# EasyEDA Pro project ProProject_IMUSensorNodes202312.epro, board 6_6_拼板20240123（不带编号） (continued)
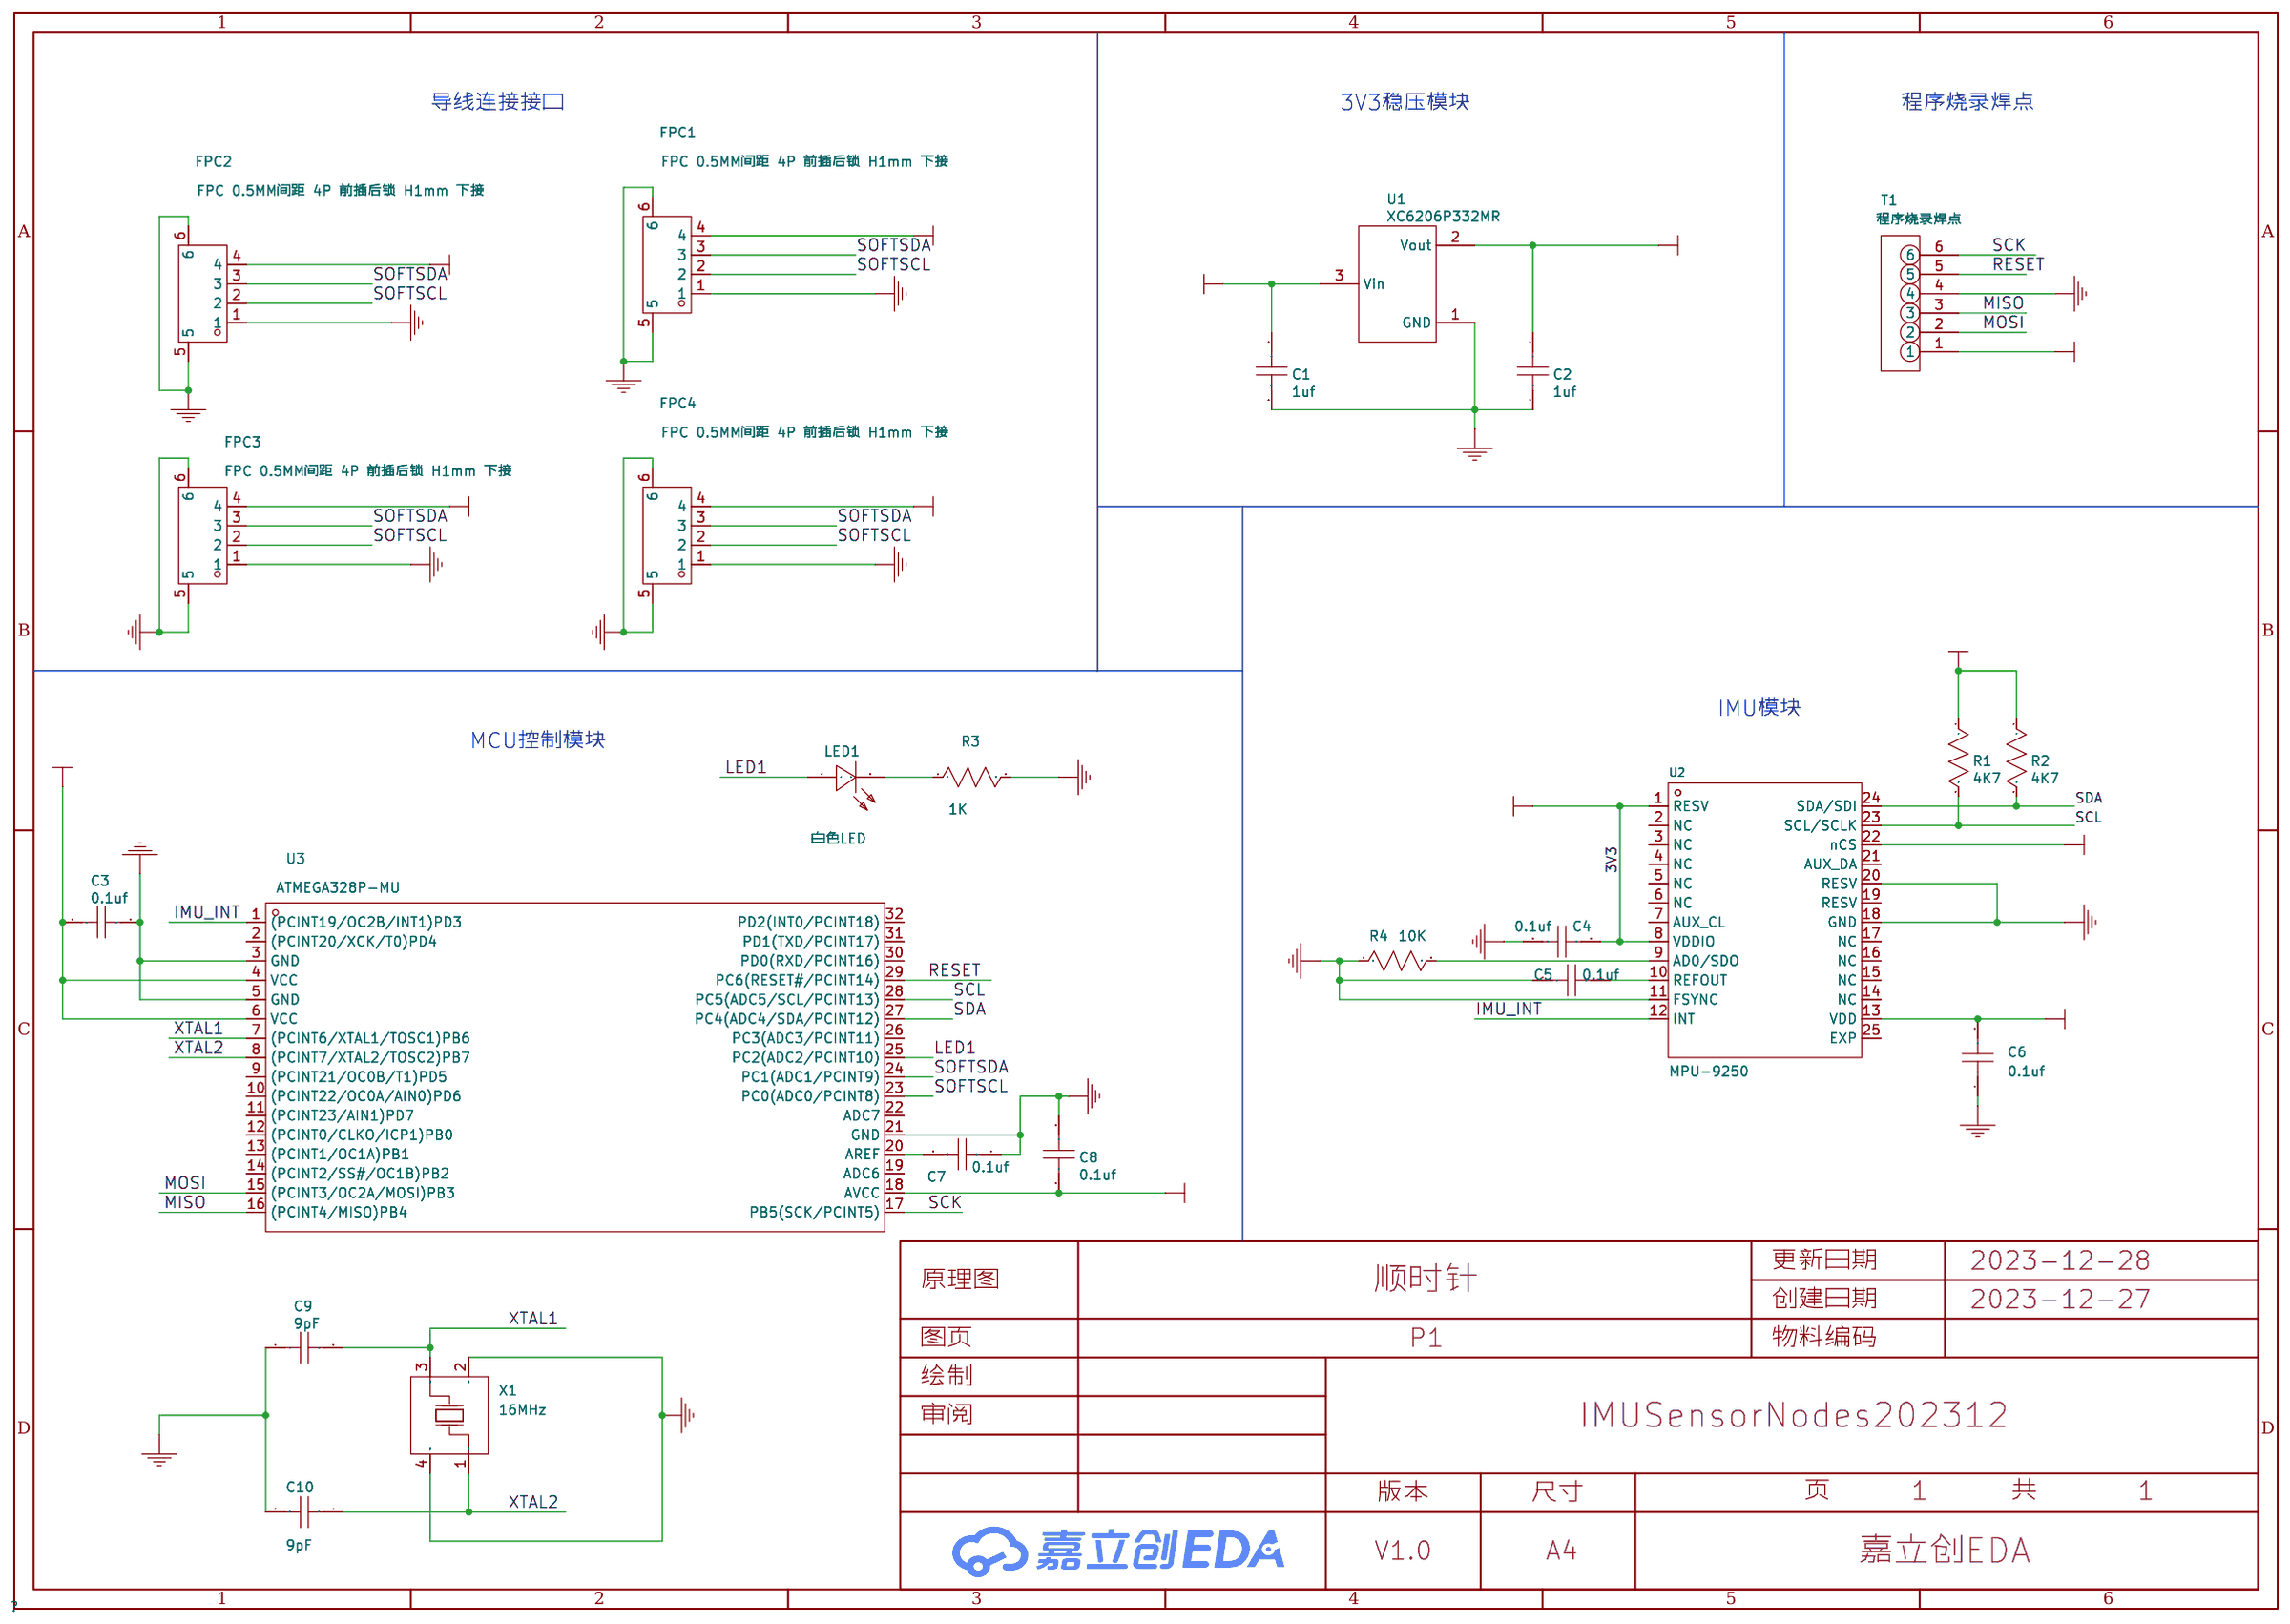
[diagram p0: schematic sheet]
## Routing (per net, layer and track width the routed paths; a pad name or vN(x,y) marks a point on that pad's centre or on a via; arc(x,y) is an arc through that point) (continued)
  vias: v1(3.33,70.26) v1(3.33,56.54) v1(3.33,42.83) v1(3.33,29.11) v1(3.33,15.4) v1(3.33,1.68) v1(17.05,69.88) v1(17.05,56.16) v1(17.05,42.45) v1(17.05,28.73) v1(17.05,15.01) v1(17.05,1.3) v1(30.64,70.26) v1(30.64,56.54) v1(30.64,42.83) v1(30.64,29.11) v1(30.64,15.4) v1(30.64,1.68) v1(44.35,69.88) v1(44.35,56.16) v1(44.35,42.45) v1(44.35,28.73) v1(44.35,15.01) v1(44.35,1.3) v1(57.94,70.26) v1(57.94,56.54) v1(57.94,42.83) v1(57.94,29.11) v1(57.94,15.4) v1(57.94,1.68) v1(71.66,69.88) v1(71.66,56.16) v1(71.66,42.45) v1(71.66,28.73) v1(71.66,15.01) v1(71.66,1.3)
SOFTSDA: length 633.1
  Top Layer w0.2: FPC2#8.2 6.25,76.73 6,76.48 3.08,76.48 2.32,75.72 2.32,75.09 2.57,74.83 FPC1#4.2 ; FPC1#13.2 2.57,6.25 2.32,6.51 2.32,7.14 3.08,7.9 6,7.9 6.25,8.15 FPC2#4.2 ; FPC1#15.3 72.43,74.33 72.93,74.83 72.93,77.75 73.31,78.13 73.92,78.13 74.08,77.98 FPC2#3.3 ; FPC2#22.3 46.77,9.4 46.62,9.55 46,9.55 45.62,9.17 45.62,6.25 45.12,5.75 FPC1#22.3 ; FPC1#7.3 72.43,5.75 72.93,6.25 72.93,9.17 73.31,9.55 73.92,9.55 74.08,9.4 FPC2#15.3 ; FPC2#2.3 46.77,77.98 46.62,78.13 46,78.13 45.62,77.75 45.62,74.83 45.12,74.33 FPC1#20.3 ; FPC1#21.2 29.88,19.96 29.62,20.22 29.62,20.86 30.38,21.62 33.31,21.62 33.56,21.87 FPC2#33.2 ; FPC1#33.3 17.82,33.18 18.32,33.68 18.32,36.61 18.7,36.99 19.31,36.99 19.47,36.83 FPC2#17.3 ; FPC2#12.2 60.86,63.02 60.61,62.77 57.69,62.77 56.93,62 56.93,61.37 57.18,61.11 FPC1#6.2 ; FPC1#3.3 72.43,33.18 72.93,33.68 72.93,36.61 73.31,36.99 73.92,36.99 74.08,36.83 FPC2#18.3 ; FPC1#5.2 2.57,19.96 2.32,20.22 2.32,20.86 3.08,21.62 6,21.62 6.25,21.87 FPC2#6.2 ; FPC1#17.2 57.18,47.4 56.93,47.65 56.93,48.29 57.69,49.05 60.61,49.05 60.86,49.3 FPC2#25.2 ; FPC1#36.2 29.88,33.68 29.62,33.94 29.62,34.57 30.38,35.33 33.31,35.33 33.56,35.59 FPC2#21.2 ; FPC2#7.2 60.86,35.59 60.61,35.33 57.69,35.33 56.93,34.57 56.93,33.94 57.18,33.68 FPC1#24.2 ; FPC2#28.3 19.47,64.26 19.31,64.42 18.7,64.42 18.32,64.04 18.32,61.12 17.82,60.61 FPC1#23.3 ; FPC2#30.3 19.47,77.98 19.31,78.13 18.7,78.13 18.32,77.75 18.32,74.83 17.82,74.33 FPC1#35.3 ; FPC2#14.3 19.47,9.4 19.31,9.55 18.7,9.55 18.32,9.17 18.32,6.25 17.82,5.75 FPC1#10.3 ; FPC1.2 2.57,61.11 2.32,61.37 2.32,62 3.08,62.77 6,62.77 6.25,63.02 FPC2#19.2 ; FPC1#14.2 29.88,61.11 29.62,61.37 29.62,62 30.38,62.77 33.31,62.77 33.56,63.02 FPC2#35.2 ; FPC2#23.2 33.56,76.73 33.31,76.48 30.38,76.48 29.62,75.72 29.62,75.09 29.88,74.83 FPC1#31.2 ; FPC1#30.3 72.43,60.61 72.93,61.12 72.93,64.04 73.31,64.42 73.92,64.42 74.08,64.26 FPC2#31.3 ; FPC2#13.2 6.25,35.59 6,35.33 3.08,35.33 2.32,34.57 2.32,33.94 2.57,33.68 FPC1#12.2 ; FPC1#28.2 57.18,6.25 56.93,6.51 56.93,7.14 57.69,7.9 60.61,7.9 60.86,8.15 FPC2#32.2 ; FPC2#34.2 60.86,21.87 60.61,21.62 57.69,21.62 56.93,20.86 56.93,20.22 57.18,19.96 FPC1#34.2 ; FPC2#11.2 60.86,76.73 60.61,76.48 57.69,76.48 56.93,75.72 56.93,75.09 57.18,74.83 FPC1#8.2 ; FPC1#26.3 45.12,33.18 45.62,33.68 45.62,36.61 46,36.99 46.62,36.99 46.77,36.83 FPC2#27.3 ; FPC1#19.3 17.82,19.46 18.32,19.97 18.32,22.89 18.7,23.27 19.31,23.27 19.47,23.11 FPC2#5.3 ; FPC2#26.3 46.77,64.26 46.62,64.42 46,64.42 45.62,64.04 45.62,61.12 45.12,60.61 FPC1#11.3 ; FPC1#25.3 72.43,19.46 72.93,19.97 72.93,22.89 73.31,23.27 73.92,23.27 74.08,23.11 FPC2#20.3 ; FPC1#29.3 72.43,46.9 72.93,47.4 72.93,50.32 73.31,50.7 73.92,50.7 74.08,50.55 FPC2.3 ; FPC1#32.2 2.57,47.4 2.32,47.65 2.32,48.29 3.08,49.05 6,49.05 6.25,49.3 FPC2#10.2 ; FPC2#24.3 46.77,50.55 46.62,50.7 46,50.7 45.62,50.32 45.62,47.4 45.12,46.9 FPC1#16.3 ; FPC1#9.3 45.12,19.46 45.62,19.97 45.62,22.89 46,23.27 46.62,23.27 46.77,23.11 FPC2#16.3 ; FPC1#18.2 29.88,47.4 29.62,47.65 29.62,48.29 30.38,49.05 33.31,49.05 33.56,49.3 FPC2#9.2 ; FPC1#27.3 17.82,46.9 18.32,47.4 18.32,50.32 18.7,50.7 19.31,50.7 19.47,50.55 FPC2#29.3 ; FPC1#2.2 29.88,6.25 29.62,6.51 29.62,7.14 30.38,7.9 33.31,7.9 33.56,8.15 FPC2#36.2
  Top Layer w0.254: v1(43.47,28.73) 43.85,29.11 43.85,29.87 ; FPC2#26.3 46.77,62.89 47.28,62.39 50.45,62.39 50.96,61.88 50.96,61.37 50.7,61.11 FPC3#24.3 48.67,61.11 48.23,60.67 48.23,57.37 48.04,57.18 47.66,57.18 47.27,57.56 FPC4#21.3 ; FPC3#17.2 35.21,60.61 34.96,60.86 34.7,60.86 34.57,60.99 34.57,64.29 34.32,64.55 33.81,64.55 33.56,64.29 FPC2#35.2 ; 43.85,71.02 43.85,70.26 v1(43.47,69.88) ; 43.85,2.44 43.85,1.68 v1(43.47,1.3) ; 16.54,2.44 16.54,1.68 v1(16.16,1.3) ; FPC3#27.2 7.9,33.18 7.65,33.43 7.4,33.43 7.27,33.56 7.27,36.86 7.02,37.11 6.51,37.11 6.25,36.86 FPC2#13.2 ; FPC2#3.3 74.08,76.61 74.58,76.1 77.75,76.1 78.26,75.59 78.26,75.09 78,74.83 FPC3#4.3 75.97,74.83 75.53,74.39 75.53,71.09 75.34,70.89 74.96,70.89 74.58,71.28 FPC4#16.3 ; 71.15,43.59 71.15,42.83 v1(70.77,42.45) ; 16.54,57.31 16.54,56.54 v1(16.16,56.16) ; FPC2#36.2 33.56,9.43 33.81,9.68 34.32,9.68 34.57,9.43 34.57,6.12 34.7,6 34.96,6 35.21,5.75 FPC3#14.2 ; FPC3#32.2 62.51,46.9 62.26,47.15 62.01,47.15 61.88,47.27 61.88,50.58 61.63,50.83 61.12,50.83 60.86,50.57 FPC2#25.2 ; FPC2#10.2 6.25,50.57 6.51,50.83 7.02,50.83 7.27,50.58 7.27,47.27 7.4,47.15 7.65,47.15 7.9,46.9 FPC3#10.2 ; FPC2#2.3 46.77,76.61 47.28,76.1 50.45,76.1 50.96,75.59 50.96,75.09 50.7,74.83 FPC3#21.3 48.67,74.83 48.23,74.39 48.23,71.09 48.04,70.89 47.66,70.89 47.27,71.28 FPC4#14.3 ; v1(16.16,42.45) 16.54,42.83 16.54,43.59 ; FPC2#30.3 19.47,76.61 19.97,76.1 23.15,76.1 23.65,75.59 23.65,75.09 23.39,74.83 FPC3#16.3 21.36,74.83 20.92,74.39 20.92,71.09 20.73,70.89 20.35,70.89 19.97,71.28 FPC4#26.3 ; FPC4#5.3 74.58,2.7 74.96,2.31 75.34,2.31 75.53,2.51 75.53,5.81 75.97,6.25 FPC3#35.3 78,6.25 78.26,6.51 78.26,7.01 77.75,7.52 74.58,7.52 74.08,8.03 FPC2#15.3 ; 16.54,71.02 16.54,70.26 v1(16.16,69.88) ; FPC2#21.2 33.56,36.86 33.81,37.11 34.32,37.11 34.57,36.86 34.57,33.56 34.7,33.43 34.96,33.43 35.21,33.18 FPC3.2 ; FPC4#2.3 47.27,2.7 47.66,2.31 48.04,2.31 48.23,2.51 48.23,5.81 48.67,6.25 FPC3#34.3 50.7,6.25 50.96,6.51 50.96,7.01 50.45,7.52 47.28,7.52 46.77,8.03 FPC2#22.3 ; FPC4#24.3 47.27,30.13 47.66,29.75 48.04,29.75 48.23,29.94 48.23,33.24 48.67,33.68 FPC3#9.3 50.7,33.68 50.96,33.94 50.96,34.45 50.45,34.95 47.28,34.95 46.77,35.46 FPC2#27.3 ; FPC3#20.2 35.21,74.33 34.96,74.58 34.7,74.58 34.57,74.7 34.57,78.01 34.32,78.26 33.81,78.26 33.56,78 FPC2#23.2 ; FPC4#9.3 74.58,57.56 74.96,57.18 75.34,57.18 75.53,57.37 75.53,60.67 75.97,61.11 FPC3#11.3 78,61.11 78.26,61.37 78.26,61.88 77.75,62.39 74.58,62.39 74.08,62.89 FPC2#31.3 ; 71.15,16.16 71.15,15.4 v1(70.77,15.01) ; 43.85,16.16 43.85,15.4 v1(43.47,15.01) ; FPC4#22.3 19.97,43.85 20.35,43.46 20.73,43.46 20.92,43.66 20.92,46.96 21.36,47.4 FPC3#28.3 23.39,47.4 23.65,47.65 23.65,48.16 23.15,48.67 19.97,48.67 19.47,49.17 FPC2#29.3 ; FPC2#33.2 33.56,23.14 33.81,23.4 34.32,23.4 34.57,23.14 34.57,19.84 34.7,19.71 34.96,19.71 35.21,19.46 FPC3#6.2 ; FPC3#36.2 7.9,74.33 7.65,74.58 7.4,74.58 7.27,74.7 7.27,78.01 7.02,78.26 6.51,78.26 6.25,78 FPC2#8.2 ; FPC3#13.2 62.51,19.46 62.26,19.71 62.01,19.71 61.88,19.84 61.88,23.14 61.63,23.4 61.12,23.4 60.86,23.14 FPC2#34.2 ; 43.85,57.31 43.85,56.54 v1(43.47,56.16) ; 71.15,2.44 71.15,1.68 v1(70.77,1.3) ; v1(70.77,69.88) 71.15,70.26 71.15,71.02 ; FPC2#6.2 6.25,23.14 6.51,23.4 7.02,23.4 7.27,23.14 7.27,19.84 7.4,19.71 7.65,19.71 7.9,19.46 FPC3#12.2 ; FPC4#28.3 19.97,16.42 20.35,16.03 20.73,16.03 20.92,16.22 20.92,19.53 21.36,19.96 FPC3#2.3 23.39,19.96 23.65,20.22 23.65,20.73 23.15,21.24 19.97,21.24 19.47,21.74 FPC2#5.3 ; FPC3#15.2 7.9,5.75 7.65,6 7.4,6 7.27,6.12 7.27,9.43 7.02,9.68 6.51,9.68 6.25,9.43 FPC2#4.2 ; FPC3#31.2 62.51,33.18 62.26,33.43 62.01,33.43 61.88,33.56 61.88,36.86 61.63,37.11 61.12,37.11 60.86,36.86 FPC2#7.2 ; FPC4#34.3 19.97,2.7 20.35,2.31 20.73,2.31 20.92,2.51 20.92,5.81 21.36,6.25 FPC3#29.3 23.39,6.25 23.65,6.51 23.65,7.01 23.15,7.52 19.97,7.52 19.47,8.03 FPC2#14.3 ; FPC2#32.2 60.86,9.43 61.12,9.68 61.63,9.68 61.88,9.43 61.88,6.12 62.01,6 62.26,6 62.51,5.75 FPC3#5.2 ; 71.15,29.87 71.15,29.11 v1(70.77,28.73) ; FPC2.3 74.08,49.17 74.58,48.67 77.75,48.67 78.26,48.16 78.26,47.65 78,47.4 FPC3#33.3 75.97,47.4 75.53,46.96 75.53,43.66 75.34,43.46 74.96,43.46 74.58,43.85 FPC4#20.3 ; FPC2#11.2 60.86,78 61.12,78.26 61.63,78.26 61.88,78.01 61.88,74.7 62.01,74.58 62.26,74.58 62.51,74.33 FPC3#25.2 ; FPC4#29.3 74.58,30.13 74.96,29.75 75.34,29.75 75.53,29.94 75.53,33.24 75.97,33.68 FPC3#23.3 78,33.68 78.26,33.94 78.26,34.45 77.75,34.95 74.58,34.95 74.08,35.46 FPC2#18.3 ; v1(70.77,56.16) 71.15,56.54 71.15,57.31 ; FPC4#32.3 47.27,16.42 47.66,16.03 48.04,16.03 48.23,16.22 48.23,19.53 48.67,19.96 FPC3#18.3 50.7,19.96 50.96,20.22 50.96,20.73 50.45,21.24 47.28,21.24 46.77,21.74 FPC2#16.3 ; FPC2#24.3 46.77,49.17 47.28,48.67 50.45,48.67 50.96,48.16 50.96,47.65 50.7,47.4 FPC3#22.3 48.67,47.4 48.23,46.96 48.23,43.66 48.04,43.46 47.66,43.46 47.27,43.85 FPC4#10.3 ; 16.54,29.87 16.54,29.11 v1(16.16,28.73) ; FPC2#20.3 74.08,21.74 74.58,21.24 77.75,21.24 78.26,20.73 78.26,20.22 78,19.96 FPC3#3.3 75.97,19.96 75.53,19.53 75.53,16.22 75.34,16.03 74.96,16.03 74.58,16.42 FPC4#31.3 ; FPC2#12.2 60.86,64.29 61.12,64.55 61.63,64.55 61.88,64.29 61.88,60.99 62.01,60.86 62.26,60.86 62.51,60.61 FPC3#30.2 ; v1(16.16,15.01) 16.54,15.4 16.54,16.16 ; FPC3#8.2 7.9,60.61 7.65,60.86 7.4,60.86 7.27,60.99 7.27,64.29 7.02,64.55 6.51,64.55 6.25,64.29 FPC2#19.2 ; FPC2#9.2 33.56,50.57 33.81,50.83 34.32,50.83 34.57,50.58 34.57,47.27 34.7,47.15 34.96,47.15 35.21,46.9 FPC3#26.2 ; FPC4#4.3 19.97,57.56 20.35,57.18 20.73,57.18 20.92,57.37 20.92,60.67 21.36,61.11 FPC3#19.3 23.39,61.11 23.65,61.37 23.65,61.88 23.15,62.39 19.97,62.39 19.47,62.89 FPC2#28.3 ; FPC4#15.3 19.97,30.13 20.35,29.75 20.73,29.75 20.92,29.94 20.92,33.24 21.36,33.68 FPC3#7.3 23.39,33.68 23.65,33.94 23.65,34.45 23.15,34.95 19.97,34.95 19.47,35.46 FPC2#17.3 ; 43.85,43.59 43.85,42.83 v1(43.47,42.45)
  vias: v1(2.44,69.75) v1(2.44,56.04) v1(2.44,42.32) v1(2.44,28.6) v1(2.44,14.89) v1(2.44,1.17) v1(29.75,69.75) v1(29.75,56.04) v1(29.75,42.32) v1(29.75,28.6) v1(29.75,14.89) v1(29.75,1.17) v1(57.05,69.75) v1(57.05,56.04) v1(57.05,42.32) v1(57.05,28.6) v1(57.05,14.89) v1(57.05,1.17)
XTAL1: length 220.2
  Bottom Layer w0.2: U3#87.7 73.92,34.3 74.2,34.57 74.91,34.57 76.74,36.4 v1(76.74,37.62) ; v1(35.79,78.77) 35.79,77.58 34.19,75.97 33.43,75.97 32.9,75.45 U3#77.7 ; v1(22.13,23.91) 22.13,22.68 20.31,20.86 19.59,20.86 19.31,20.58 U3#95.7 ; v1(35.79,51.34) 35.79,50.14 34.19,48.54 33.43,48.54 32.9,48.02 U3#75.7 ; U3#92.7 32.9,6.87 33.43,7.4 34.19,7.4 35.79,9 v1(35.79,10.19) ; v1(8.49,10.19) 8.49,9 6.89,7.4 6.13,7.4 5.6,6.87 U3#91.7 ; v1(49.43,51.34) 49.43,50.11 47.61,48.29 46.89,48.29 46.62,48.02 U3#64.7 ; v1(49.43,78.77) 49.43,77.55 47.61,75.72 46.89,75.72 46.62,75.45 U3#69.7 ; v1(8.49,23.91) 8.49,22.71 6.89,21.11 6.13,21.11 5.6,20.58 U3#72.7 ; v1(76.74,51.34) 76.74,50.11 74.91,48.29 74.2,48.29 73.92,48.02 U3#67.7 ; v1(63.1,37.62) 63.1,36.43 61.5,34.83 60.74,34.83 60.21,34.3 U3#82.7 ; U3#78.7 46.62,61.73 46.89,62 47.61,62 49.43,63.83 v1(49.43,65.05) ; v1(35.79,37.62) 35.79,36.43 34.19,34.83 33.43,34.83 32.9,34.3 U3#70.7 ; U3#84.7 19.31,48.02 19.59,48.29 20.31,48.29 22.13,50.11 v1(22.13,51.34) ; v1(49.43,23.91) 49.43,22.68 47.61,20.86 46.89,20.86 46.62,20.58 U3#62.7 ; U3#74.7 5.6,61.73 6.13,62.26 6.89,62.26 8.49,63.86 v1(8.49,65.05) ; U3#94.7 73.92,20.58 74.2,20.86 74.91,20.86 76.74,22.68 v1(76.74,23.91) ; v1(76.74,78.77) 76.74,77.55 74.91,75.72 74.2,75.72 73.92,75.45 U3#83.7 ; U3#73.7 32.9,20.58 33.43,21.11 34.19,21.11 35.79,22.71 v1(35.79,23.91) ; U3#63.7 60.21,61.73 60.74,62.26 61.5,62.26 63.1,63.86 v1(63.1,65.05) ; v1(22.13,65.05) 22.13,63.83 20.31,62 19.59,62 19.31,61.73 U3#88.7 ; v1(49.43,10.19) 49.43,8.97 47.61,7.14 46.89,7.14 46.62,6.87 U3#86.7 ; v1(76.74,10.19) 76.74,8.97 74.91,7.14 74.2,7.14 73.92,6.87 U3#80.7 ; U3#61.7 73.92,61.73 74.2,62 74.91,62 76.74,63.83 v1(76.74,65.05) ; U3#66.7 60.21,75.45 60.74,75.97 61.5,75.97 63.1,77.58 v1(63.1,78.77) ; U3#89.7 60.21,48.02 60.74,48.54 61.5,48.54 63.1,50.14 v1(63.1,51.34) ; v1(22.13,37.62) 22.13,36.4 20.31,34.57 19.59,34.57 19.31,34.3 U3#81.7 ; v1(35.79,65.05) 35.79,63.86 34.19,62.26 33.43,62.26 32.9,61.73 U3#76.7 ; U3#85.7 60.21,6.87 60.74,7.4 61.5,7.4 63.1,9 v1(63.1,10.19) ; v1(8.49,78.77) 8.49,77.58 6.89,75.97 6.13,75.97 5.6,75.45 U3#96.7 ; v1(22.13,10.19) 22.13,8.97 20.31,7.14 19.59,7.14 19.31,6.87 U3#90.7 ; v1(8.49,51.34) 8.49,50.14 6.89,48.54 6.13,48.54 5.6,48.02 U3#68.7 ; U3#65.7 5.6,34.3 6.13,34.83 6.89,34.83 8.49,36.43 v1(8.49,37.62) ; U3#93.7 60.21,20.58 60.74,21.11 61.5,21.11 63.1,22.71 v1(63.1,23.91) ; U3#71.7 19.31,75.45 19.59,75.72 20.31,75.72 22.13,77.55 v1(22.13,78.77) ; U3#79.7 46.62,34.3 46.89,34.57 47.61,34.57 49.43,36.4 v1(49.43,37.62)
  Bottom Layer w0.254: 8.54,51.34 8.54,51.49 C9#31.2 ; 63.15,23.91 63.15,24.06 C9.2 ; 8.54,65.05 8.54,65.21 C9#25.2 ; 22.64,10.7 v1(22.13,10.19) ; 22.64,65.56 v1(22.13,65.05) ; 77.25,38.13 v1(76.74,37.62) ; 35.84,51.34 35.84,51.49 C9#33.2 ; 8.54,23.91 8.54,24.06 C9#10.2 ; C9#12.2 35.84,24.06 35.84,23.91 ; C9#35.2 63.15,51.49 63.15,51.34 ; 63.15,37.62 63.15,37.78 C9#7.2 ; 8.54,78.77 8.54,78.92 C9#20.2 ; 35.84,65.05 35.84,65.21 C9#27.2 ; 22.64,79.28 v1(22.13,78.77) ; 8.54,37.62 8.54,37.78 C9#3.2 ; 49.94,38.13 v1(49.43,37.62) ; 77.25,10.7 v1(76.74,10.19) ; C9#14.2 8.54,10.34 8.54,10.19 ; C9#5.2 35.84,37.78 35.84,37.62 ; 77.25,79.28 v1(76.74,78.77) ; 49.94,51.84 v1(49.43,51.34) ; C9#16.2 35.84,10.34 35.84,10.19 ; 49.94,10.7 v1(49.43,10.19) ; 35.84,78.77 35.84,78.92 C9#23.2 ; 22.64,24.41 v1(22.13,23.91) ; 49.94,24.41 v1(49.43,23.91) ; 77.25,51.84 v1(76.74,51.34) ; 49.94,79.28 v1(49.43,78.77) ; 77.25,65.56 v1(76.74,65.05) ; C9#21.2 63.15,78.92 63.15,78.77 ; 63.15,65.05 63.15,65.21 C9#29.2 ; 22.64,51.84 v1(22.13,51.34) ; 22.64,38.13 v1(22.13,37.62) ; 77.25,24.41 v1(76.74,23.91) ; 49.94,65.56 v1(49.43,65.05) ; C9#18.2 63.15,10.34 63.15,10.19
XTAL2: length 162.6
  Top Layer w0.254: v1(22.76,36.22) 23.27,36.22 ; v1(50.07,77.37) 50.58,77.37 ; v1(22.76,77.37) 23.27,77.37 ; v1(77.37,63.66) 77.88,63.66 ; v1(22.76,49.94) 23.27,49.94 ; v1(50.07,36.22) 50.58,36.22 ; v1(50.07,22.51) 50.58,22.51 ; v1(50.07,49.94) 50.58,49.94 ; v1(22.76,22.51) 23.27,22.51 ; v1(77.37,49.94) 77.88,49.94 ; v1(22.76,63.66) 23.27,63.66 ; v1(77.37,36.22) 77.88,36.22 ; v1(77.37,22.51) 77.88,22.51 ; v1(22.76,8.79) 23.27,8.79 ; v1(77.37,8.79) 77.88,8.79 ; v1(50.07,63.66) 50.58,63.66 ; v1(50.07,8.79) 50.58,8.79 ; v1(77.37,77.37) 77.88,77.37
  Bottom Layer w0.2: U3#69.8 47.27,74.95 49.69,77.37 v1(50.07,77.37) ; U3#76.8 33.68,61.24 35.84,63.4 v1(36.35,63.4) ; v1(63.66,63.4) 63.15,63.4 60.99,61.24 U3#63.8 ; v1(22.76,8.79) 22.38,8.79 19.96,6.37 U3#90.8 ; v1(77.37,36.22) 76.99,36.22 74.57,33.81 U3#87.8 ; v1(63.66,77.12) 63.15,77.12 60.99,74.95 U3#66.8 ; v1(9.05,77.12) 8.54,77.12 6.38,74.95 U3#96.8 ; v1(50.07,36.22) 49.69,36.22 47.27,33.81 U3#79.8 ; U3#67.8 74.57,47.52 76.99,49.94 v1(77.37,49.94) ; v1(22.76,77.37) 22.38,77.37 19.96,74.95 U3#71.8 ; U3#80.8 74.57,6.37 76.99,8.79 v1(77.37,8.79) ; U3#77.8 33.68,74.95 35.84,77.12 v1(36.35,77.12) ; v1(22.76,49.94) 22.38,49.94 19.96,47.52 U3#84.8 ; U3#89.8 60.99,47.52 63.15,49.69 v1(63.66,49.69) ; v1(77.37,63.66) 76.99,63.66 74.57,61.24 U3#61.8 ; U3#72.8 6.38,20.09 8.54,22.25 v1(9.05,22.25) ; v1(9.05,63.4) 8.54,63.4 6.38,61.24 U3#74.8 ; U3#91.8 6.38,6.37 8.54,8.54 v1(9.05,8.54) ; U3#78.8 47.27,61.24 49.69,63.66 v1(50.07,63.66) ; v1(50.07,49.94) 49.69,49.94 47.27,47.52 U3#64.8 ; U3#83.8 74.57,74.95 76.99,77.37 v1(77.37,77.37) ; U3#88.8 19.96,61.24 22.38,63.66 v1(22.76,63.66) ; v1(50.07,8.79) 49.69,8.79 47.27,6.37 U3#86.8 ; U3#82.8 60.99,33.81 63.15,35.97 v1(63.66,35.97) ; U3#73.8 33.68,20.09 35.84,22.25 v1(36.35,22.25) ; v1(9.05,49.69) 8.54,49.69 6.38,47.52 U3#68.8 ; v1(77.37,22.51) 76.99,22.51 74.57,20.09 U3#94.8 ; U3#93.8 60.99,20.09 63.15,22.25 v1(63.66,22.25) ; U3#62.8 47.27,20.09 49.69,22.51 v1(50.07,22.51) ; v1(9.05,35.97) 8.54,35.97 6.38,33.81 U3#65.8 ; v1(22.76,22.51) 22.38,22.51 19.96,20.09 U3#95.8 ; v1(36.35,35.97) 35.84,35.97 33.68,33.81 U3#70.8 ; v1(36.35,49.69) 35.84,49.69 33.68,47.52 U3#75.8 ; v1(36.35,8.54) 35.84,8.54 33.68,6.37 U3#92.8 ; v1(63.66,8.54) 63.15,8.54 60.99,6.37 U3#85.8 ; U3#81.8 19.96,33.81 22.38,36.22 v1(22.76,36.22)
  Bottom Layer w0.254: v1(50.07,8.79) 50.3,9.02 C10#17.1 ; C10#6.1 50.3,36.45 v1(50.07,36.22) ; v1(22.76,49.94) 22.99,50.17 C10#32.1 ; C10#11.1 22.99,22.74 v1(22.76,22.51) ; C10#30.1 77.6,63.88 v1(77.37,63.66) ; v1(77.37,49.94) 77.6,50.17 C10#36.1 ; v1(77.37,8.79) 77.6,9.02 C10#19.1 ; C10#4.1 22.99,36.45 v1(22.76,36.22) ; C10#22.1 22.99,77.6 v1(22.76,77.37) ; v1(50.07,63.66) 50.3,63.88 C10#28.1 ; C10#9.1 77.6,77.6 v1(77.37,77.37) ; C10#2.1 77.6,22.74 v1(77.37,22.51) ; v1(50.07,49.94) 50.3,50.17 C10#34.1 ; v1(77.37,36.22) 77.6,36.45 C10#8.1 ; C10#15.1 22.99,9.02 v1(22.76,8.79) ; C10#24.1 50.3,77.6 v1(50.07,77.37) ; v1(50.07,22.51) 50.3,22.74 C10#13.1 ; v1(22.76,63.66) 22.99,63.88 C10#26.1
$1N1156: length 14
  Bottom Layer w0.254: U3#87.20 72.95,28.96 C7#5.2 ; U3#69.20 45.65,70.11 C7#23.2 ; U3#83.20 72.95,70.11 C7#6.2 ; C7.2 18.34,28.96 U3#81.20 ; C7#25.2 18.34,56.39 U3#88.20 ; U3#79.20 45.65,28.96 C7#3.2 ; U3#78.20 45.65,56.39 C7#27.2 ; U3#61.20 72.95,56.39 C7#29.2 ; C7#31.2 18.34,42.68 U3#84.20 ; U3#90.20 18.34,1.53 C7#14.2 ; C7#18.2 72.95,1.53 U3#80.20 ; C7#33.2 45.65,42.68 U3#64.20 ; U3#67.20 72.95,42.68 C7#35.2 ; U3#94.20 72.95,15.25 C7#12.2 ; C7#21.2 18.34,70.11 U3#71.20 ; U3#95.20 18.34,15.25 C7#8.2 ; U3#86.20 45.65,1.53 C7#16.2 ; U3#62.20 45.65,15.25 C7#10.2
$1N1216: length 20.5
  Bottom Layer w0.254: R4#29.2 74.88,64.49 U2#32.9 ; R4#16.2 47.58,9.63 U2#19.9 ; U2#22.9 20.27,23.34 R4#9.2 ; 47.05,78.21 47.58,78.21 R4#23.2 ; U2#12.9 20.27,64.49 R4#25.2 ; U2#20.9 74.88,9.63 R4#18.2 ; R4#27.2 47.58,64.49 U2#34.9 ; U2#18.9 20.27,9.63 R4#14.2 ; R4#33.2 47.58,50.78 U2#5.9 ; R4#11.2 47.58,23.34 U2#2.9 ; U2#35.9 74.88,23.34 R4.2 ; U2#6.9 74.88,50.78 R4#35.2 ; 74.36,78.21 74.88,78.21 R4#7.2 ; U2#14.9 20.27,50.78 R4#31.2 ; R4#6.2 74.88,37.06 U2#16.9 ; U2#28.9 20.27,37.06 R4#2.2 ; 19.75,78.21 20.27,78.21 R4#21.2 ; U2#3.9 47.58,37.06 R4#4.2
$1N1217: length 16.3
  Bottom Layer w0.254: U2#22.10 20.65,22.94 ; U2#20.10 75.26,9.23 ; U2#28.10 20.65,36.66 ; U2#16.10 75.26,36.66 ; U2#3.10 47.96,36.66 ; U2#24.10 47.96,77.81 ; U2#19.10 47.96,9.23 ; U2#14.10 20.65,50.38 ; U2#2.10 47.96,22.94 ; U2#18.10 20.65,9.23 ; U2#34.10 47.96,64.09 ; U2#6.10 75.26,50.38 ; U2#36.10 75.26,77.81 ; U2#35.10 75.26,22.94 ; U2#32.10 75.26,64.09 ; U2#5.10 47.96,50.38 ; U2#12.10 20.65,64.09 ; U2#7.10 20.65,77.81
$1N1698: length 22.8
  Bottom Layer w0.2: R4#32.2 33.99,50.78 U2#21.9 ; U2#31.9 33.99,64.49 R4#26.2 ; R4#15.2 33.99,9.63 U2#25.9 ; 6.03,78.21 6.68,78.21 R4#19.2 ; U2#4.9 6.68,37.06 R4#36.2 ; 33.34,78.21 33.99,78.21 R4#22.2 ; R4#13.2 6.68,9.63 U2#11.9 ; R4#24.2 6.68,64.49 U2#29.9 ; U2#23.9 61.29,9.63 R4#17.2 ; R4#34.2 61.29,50.78 U2#26.9 ; U2#9.9 33.99,23.34 R4#10.2 ; R4#30.2 6.68,50.78 U2#30.9 ; R4#8.2 6.68,23.34 U2#33.9 ; U2#8.9 33.99,37.06 R4#3.2 ; R4#20.2 61.29,78.21 60.64,78.21 ; U2#10.9 61.29,37.06 R4#5.2 ; U2#13.9 61.29,64.49 R4#28.2 ; U2#17.9 61.29,23.34 R4#12.2
$1N1725: length 20.1
  Bottom Layer w0.2: U2#23.10 61.65,9.23 C5#18.2 ; C5#14.2 7.04,9.23 U2#11.10 ; U2#15.10 61.65,77.81 C5#22.2 ; C5#27.2 34.35,64.09 U2#31.10 ; C5#6.2 61.65,36.66 U2#10.10 ; U2#26.10 61.65,50.38 C5#35.2 ; C5#13.2 61.65,22.94 U2#17.10 ; C5#9.2 7.04,22.94 U2#33.10 ; U2#27.10 34.35,77.81 C5#23.2 ; C5#31.2 7.04,50.38 U2#30.10 ; U2#4.10 7.04,36.66 C5#2.2 ; C5#33.2 34.35,50.38 U2#21.10 ; U2#13.10 61.65,64.09 C5#29.2 ; U2#9.10 34.35,22.94 C5#11.2 ; C5#25.2 7.04,64.09 U2#29.10 ; C5#20.2 7.04,77.81 U2.10 ; U2#8.10 34.35,36.66 C5#4.2 ; U2#25.10 34.35,9.23 C5#16.2

## Copper pours and planes (outline as drawn; the poured copper is in the pictures)
5V on Top Layer: 59.74,6.88 61.49,6.88 61.49,5.09 59.74,5.09
5V on Top Layer: 18.97,6.76 20.48,6.76 20.48,5.24 18.97,5.24
5V on Top Layer: 46.27,47.91 47.78,47.91 47.78,46.38 46.27,46.38
5V on Top Layer: 5.13,75.46 6.88,75.46 6.88,73.67 5.13,73.67
5V on Top Layer: 18.97,47.91 20.48,47.91 20.48,46.38 18.97,46.38
5V on Top Layer: 32.44,61.74 34.19,61.74 34.19,59.95 32.44,59.95
5V on Top Layer: 32.44,34.31 34.19,34.31 34.19,32.52 32.44,32.52
5V on Top Layer: 73.58,20.48 75.09,20.48 75.09,18.95 73.58,18.95
5V on Top Layer: 73.58,61.63 75.09,61.63 75.09,60.1 73.58,60.1
5V on Top Layer: 59.74,75.46 61.49,75.46 61.49,73.67 59.74,73.67
5V on Top Layer: 32.44,20.59 34.19,20.59 34.19,18.81 32.44,18.81
5V on Top Layer: 18.97,34.19 20.48,34.19 20.48,32.67 18.97,32.67
5V on Top Layer: 46.27,34.19 47.78,34.19 47.78,32.67 46.27,32.67
5V on Top Layer: 18.97,61.63 20.48,61.63 20.48,60.1 18.97,60.1
5V on Top Layer: 73.58,75.34 75.09,75.34 75.09,73.82 73.58,73.82
5V on Top Layer: 73.58,47.91 75.09,47.91 75.09,46.38 73.58,46.38
5V on Top Layer: 46.27,75.34 47.78,75.34 47.78,73.82 46.27,73.82
5V on Top Layer: 46.27,61.63 47.78,61.63 47.78,60.1 46.27,60.1
5V on Top Layer: 46.27,20.48 47.78,20.48 47.78,18.95 46.27,18.95
5V on Top Layer: 59.74,48.02 61.49,48.02 61.49,46.24 59.74,46.24
5V on Top Layer: 5.13,61.74 6.88,61.74 6.88,59.95 5.13,59.95
5V on Top Layer: 18.97,75.34 20.48,75.34 20.48,73.82 18.97,73.82
5V on Top Layer: 59.74,20.59 61.49,20.59 61.49,18.81 59.74,18.81
5V on Top Layer: 32.44,6.88 34.19,6.88 34.19,5.09 32.44,5.09
5V on Top Layer: 5.13,48.02 6.88,48.02 6.88,46.24 5.13,46.24
